# EasyEDA Pro project MushIO_V1p0_Final.eprj, board ADS124S08_ADC
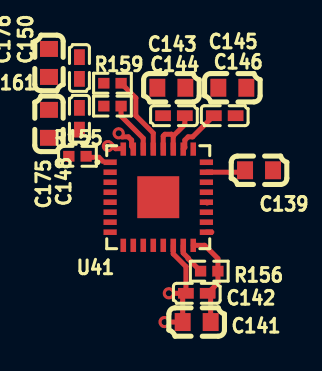
[diagram p9: board, top side]
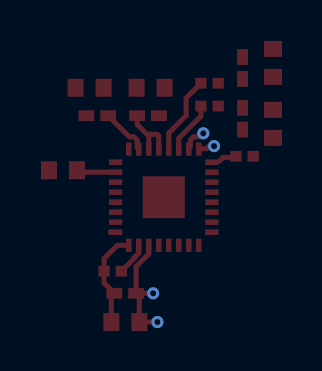
[diagram p10: board, bottom side, seen from below]

No outline. copper layers: Top Layer, Bottom Layer. Coordinates in mm from the lowest, leftmost part position.
Stack: Top Layer 0.035mm / Dielectric1 1.51mm FR4 er 4.5 / Bottom Layer 0.035mm

## Design rules (mm)
template: JLCPCB Capability(Two Layers Board)
spacing copperThickness1oz (default): track to track 0.102, other pairs 0.152 to 0.3
spacing copperThickness2oz: track to track 0.203, other pairs 0.152 to 0.3
track width copperThickness1oz (default): min 0.127, default 0.254, max 2.54
track width copperThickness2oz: min 0.203, default 0.254, max 2.54
differential pair differentialPair (default): width min 0.127, default 0.254, max 2.54; gap min 0.152, default 0.152
via viaSize (default): diameter min 0.5, default 0.61, max 10; hole min 0.3, default 0.305, max 6.3

## Placement (name value [footprint] x y rotation side)
C139  10uF  [C0603]  10.51 7.6 0 top
C141  10uF  [C0603]  7.39 0 0 top
C142  100nF  [C0402]  7.39 1.44 0 top
C143  10uF  [C0603]  6.12 11.73 0 top
C144  100nF  [C0402]  6.25 10.33 0 top
C145  10uF  [C0603]  9.17 11.73 0 top
C146  100nF  [C0402]  8.79 10.33 0 top
C148  100nF  [C0402]  1.52 10.17 90 top
C150  100nF  [C0402]  1.52 12.71 90 top
C175  10uF  [C0603]  0 9.92 90 top
C176  10uF  [C0603]  0 12.97 90 top
R155  0Ω  [R0402]  1.43 8.3 180 top
R156  0Ω  [R0402]  8.02 2.55 180 top
R159  0Ω  [R0402]  3.18 10.81 0 top
R161  0Ω  [R0402]  3.18 11.95 0 top
U41  ADS124S08IRHBT  [VQFN-32_L5.0-W5.0-P0.50-TL-EP2.1]  5.47 6.25 0 top

## Footprints (pads in the part's own frame, mm; a bottom-side part is the same pattern mirrored in y, then rotated)
C0402
  rect 0.79x0.54 smd: 1(-0.545,0) 2(0.545,0)
C0603
  rect 0.8x0.9 smd: 1(-0.7,0) 2(0.7,0)
R0402
  rect 0.566x0.54 smd: 1(-0.433,0) 2(0.433,0)
VQFN-32_L5.0-W5.0-P0.50-TL-EP2.1
  rect 0.665x0.28 smd: 1(-2.408,1.75) 2(-2.408,1.25) 3(-2.408,0.75) 4(-2.408,0.25) 5(-2.408,-0.25) 6(-2.408,-0.75) 7(-2.408,-1.25) 8(-2.408,-1.75) 17(2.408,-1.75) 18(2.408,-1.25) 19(2.408,-0.75) 20(2.408,-0.25) 21(2.408,0.25) 22(2.408,0.75) 23(2.408,1.25) 24(2.408,1.75)
  rect 0.28x0.665 smd: 9(-1.75,-2.408) 10(-1.25,-2.408) 11(-0.75,-2.408) 12(-0.25,-2.408) 13(0.25,-2.408) 14(0.75,-2.408) 15(1.25,-2.408) 16(1.75,-2.408) 25(1.75,2.408) 26(1.25,2.408) 27(0.75,2.408) 28(0.25,2.408) 29(-0.25,2.408) 30(-0.75,2.408) 31(-1.25,2.408) 32(-1.75,2.408)
  rect 2.1x2.1 smd: 33(0,0)

## Nets
As in the schematic.

Pads without a net: U41 25

## Via types
v1: diameter 0.61, hole 0.305, Top Layer to Bottom Layer, 4 vias

## Routing (per net, layer and track width the routed paths; a pad name or vN(x,y) marks a point on that pad's centre or on a via; arc(x,y) is an arc through that point)
AVDD_2V5: length 2.4
  Top Layer w0.254: C146.1 7.18,9.27 6.96,9.27 6.8,9.1 6.8,8.74 U41.26
AVSS_N2V5: length 3.1
  Top Layer w0.254: U41.27 6.22,9.31 ; 6.22,9.31 6.12,9.4 5.8,9.4 5.72,9.31 U41.28 ; 6.22,9.31 6.8,9.89 C144.2
DVDD_3V3: length 5
  Top Layer w0.254: U41.16 7.79,3.84 8.45,3.18 R156.1 8.45,1.95 C142.2 8.09,1.29 C141.2
GND: length 5.9
  Top Layer w0.254: v1(5.78,0) C141.1 6.69,1.28 C142.1 ; C142.1 6.85,2.78 6.22,3.41 U41.14 ; C142.1 v1(6,1.44)
ADC_CLK: length 0.3
  Top Layer w0.254: U41.17 8.14,4.5
VOUT_G: length 0.9
  Top Layer w0.254: U41.32 3.69,8.68 3.33,8.68 3.15,8.86 3,8.86 v1(2.95,8.8)
VOUT_H: length 1.3
  Top Layer w0.254: U41.31 4.22,8.72 4.13,8.8 4.13,9.1 3.97,9.27 3.66,9.27 v1(3.49,9.44)
VOUT_K: length 0.1
  Top Layer w0.254: 7.91,5.96 U41.20
$2N673: length 2.1
  Top Layer w0.254: 9.93,7.34 9.78,7.5 U41.23
$2N1227: length 1
  Top Layer w0.254: 2.69,8.04 2.49,8.24 1.78,8.24
$2N1525: length 1.7
  Top Layer w0.254: U41.15 6.72,3.45 6.96,3.2 6.96,3.17 R156.2
$2N2371: length 2.6
  Top Layer w0.254: U41.30 4.72,9.2 3.61,10.3 R159.2
$2N2417: length 4
  Top Layer w0.254: U41.29 5.22,9.46 4.35,10.33 4.35,11.21 R161.2
